# EasyEDA Pro project AgOopenHardwareMicro.eprj, board PCB_AIO v4.5 Micro AMP 2024-02-05 (continued)
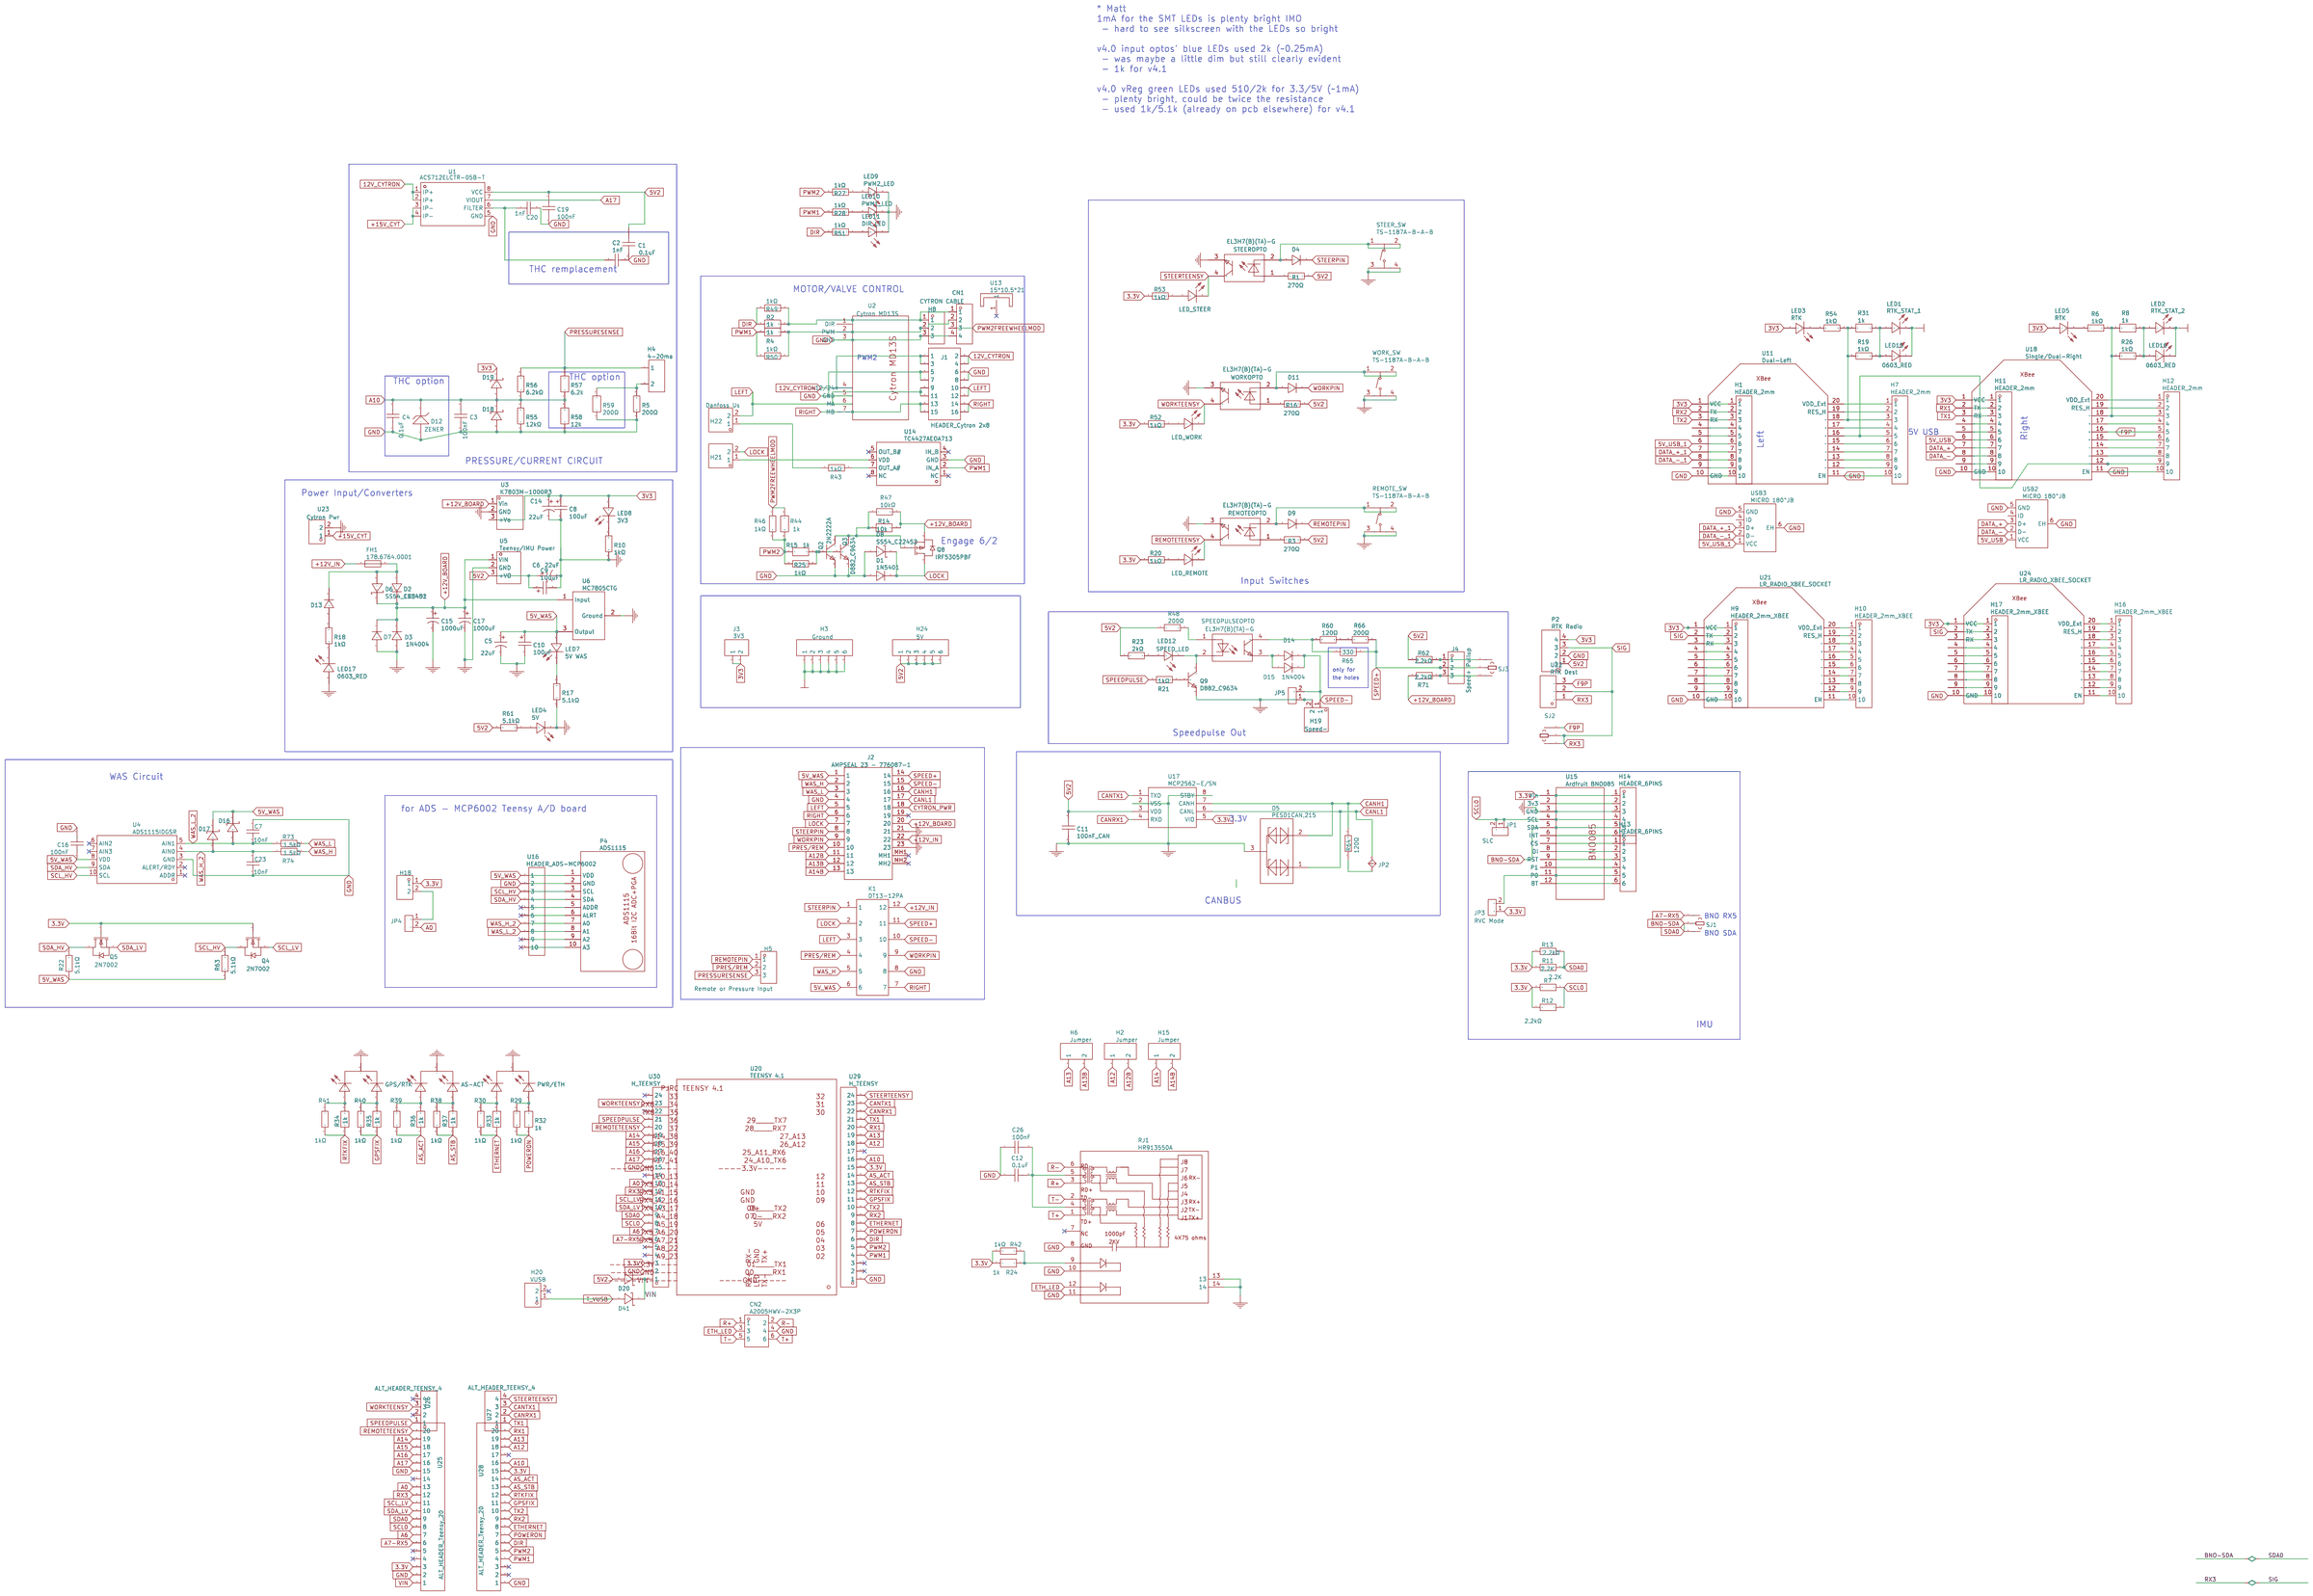
[diagram p0: schematic sheet]
## Routing (per net, layer and track width the routed paths; a pad name or vN(x,y) marks a point on that pad's centre or on a via; arc(x,y) is an arc through that point) (continued)
SPEED-: length 83
  Top Layer w0.254: 41.37,94.99 D14.1
  Inner2 w0.254: 12.8,113.19 12.83,113.19 12.83,110.99 8.38,106.55 8.38,96.77 10.16,94.99 35.18,94.99 36.58,93.34 39.75,93.34 41.37,94.99 ; D15.2 42.77,93.59 53.09,93.59 57.15,95.37 60.96,95.37 62.23,96.64 H19.1
  Bottom Layer w0.254: H19.1 JP5.2
SPEEDPULSE: length 54.6
  Top Layer w0.254: R21.2 57.4,64.89 v3(57.53,64.76)
  Inner2 w0.254: v3(57.53,64.76) 69.09,64.76 76.45,57.4 94.62,57.4 U30.21
STEERPIN: length 97.7
  Top Layer w0.254: v3(85.22,147.69) D4.1
  Inner1 w0.254: v3(28.96,141.47) 24.89,137.41 24.89,122.55 23.37,121.02 23.37,117.75 J2.8
  Bottom Layer w0.254: v3(85.22,147.69) 84.2,147.69 82.05,149.85 60.32,149.85 51.94,141.47 v3(28.96,141.47)
STEERTEENSY: length 132.4
  Top Layer w0.254: STEEROPTO.4 105.03,140.45 102.87,142.61 v3(89.92,142.61)
  Inner1 w0.254: v3(89.92,142.61) 89.92,115.05 98.3,106.67 98.3,53.08 99.31,52.37 101.35,50.34 101.35,38.22 U29.24
T+: length 63.2
  Inner1 w0.254: CN2.6 61.71,43.25
  Bottom Layer w0.254: RJ1.1 12.86,69.42 14.86,67.43 16.64,67.43 17.91,66.16 18.67,66.16 34.16,50.67 34.54,50.41 34.54,48.51 38.23,44.82 42.8,44.82 44.58,43.43 53.97,43.43 56.01,41.52 61.21,41.52 61.71,43.26
T-: length 63.2
  Bottom Layer w0.254: CN2.5 59.99,43.26 60.71,42.54 60.71,42.16 60.58,42.03 56.39,42.03 54.23,43.93 44.96,43.93 43.05,45.46 38.48,45.46 35.05,48.89 35.05,51.17 34.8,51.43 34.16,51.43 18.92,66.67 18.16,66.67 16.76,68.06 16.76,69.84 16.38,70.6 15.75,70.6 15.24,70.35 14.99,69.72 RJ1.2
T_VUSB: length 3.3
  Top Layer w0.584: D41.2 48.26,46.86 48.51,47.11 H20.1
TX1: length 96.6
  Bottom Layer w0.254: U29.21 97.54,33.9 93.17,29.54 78.71,29.54 72.88,23.71 29.85,23.71 U18.3
TX2: length 60.7
  Bottom Layer w0.254: U29.10 69.6,34.92 66.8,37.71 62.54,37.71 62.03,37.2 17.56,37.2 H1.3
U2_1: length 19.2
  Top Layer w0.254: R49.1 R2.2
  Inner2 w0.254: R2.2 68.07,61.71 67.44,60.95 61.47,60.95 CN1.1 61.09,58.02 U2.1
U2_2: length 17.9
  Top Layer w0.254: 65.15,62.87 65.28,62.99 R50.1
  Inner2 w0.254: R4.2 58.8,62.73 CN1.2 58.55,59.56 U2.2
U11_16: length 32.8
  Inner2 w0.254: H7.5 28.45,42.76 28.45,31.62 27.05,30.22 25.78,30.22 24.78,29.22 24.78,28.69
U11_18: length 21.8
  Top Layer w0.254: 10.65,50.54 12.78,52.67 H7.3 ; 10.41,50.54 15.44,50.54 16.58,51.68 R54.1
U14_6: length 10.2
  Top Layer w0.6: 58.22,85.43 56.55,85.43 55.12,83.99 55.12,81.91 56.9,80.13 H21.1
U14_7: length 17.4
  Top Layer w0.6: 68.33,82.21 65.74,79.62 59.31,79.62 56.39,82.54 56.39,83.69 56.9,84.19 58.17,84.19
U15_11: length 7.4
  Top Layer w0.254: JP3.2 89.15,86.73 91.95,83.94 U15.11
U18_18: length 21.8
  Top Layer w0.254: 10.41,24.63 R8.2 25.4,24.63 26.03,25.77 R6.1 ; 12.78,28.69 12.78,26.76 10.65,24.63
U26_3: length 0.8
  Inner2 w0.254: 41.4,92.32 40.64,92.32
WAS_H: length 69.3
  Top Layer w0.254: R74.2 78.1,125.6 v3(77.6,126.1)
  Inner2 w0.254: J2.2 16.8,135.66 17.66,136.52 19.56,136.52 20.32,137.28 32.02,137.28 32.78,136.52 59.82,136.52 v3(59.82,135.88)
  Bottom Layer w0.254: v3(77.6,126.1) 68.71,126.1 59.82,134.99 v3(59.82,135.88)
WAS_H_2: length 41.5
  Top Layer w0.254: 80.76,124.48 v3(77.34,124.48) ; C23.2 81.5,123.31 80.76,124.04 R74.1 ; v3(72.01,124.45) 71.4,124.45 71.37,124.48 ; 75.43,120.31 75.43,118.98 75.18,118.74 72.26,118.74 71.37,119.63 71.37,136.52 69.34,138.55 P4.7
  Bottom Layer w0.254: v3(72.01,124.45) 77.31,124.45 v3(77.34,124.48)
WAS_L: length 77.5
  Top Layer w0.254: v3(77.85,118.74) R73.2
  Inner2 w0.254: J2.3 17.78,131.18 20.57,133.6 35.81,132.07 38.99,134.23 54.23,134.23 61.21,127.25 64.77,127.25 66.17,125.85 66.17,117.34 67.18,116.32 70.87,116.32 73.28,118.74 v3(77.85,118.74)
WAS_L_2: length 37.2
  Top Layer w0.254: 75.93,118.1 77.09,118.1 77.6,117.59 80.26,117.59 80.76,118.11 R73.1 80.76,120.29 81.5,121.02 C7.1 ; 75.93,118.1 71.88,118.1 70.74,119.25 70.74,133.98 68.71,136.01 P4.8 ; 75.93,118.1 75.93,120.31
WORKPIN: length 101.2
  Top Layer w0.254: 87.12,155.85 85.95,155.85 v3(85.09,156.71)
  Inner1 w0.254: 12.83,137.19 5.9,137.19 5.9,145.08 17.53,156.71 v3(85.09,156.71)
WORKTEENSY: length 124.1
  Top Layer w0.254: v3(99.44,152.27) 103.12,152.27 105.03,150.36 WORKOPTO.4
  Inner1 w0.254: v3(99.44,152.27) 91.82,152.27 90.68,151.12 90.68,116.32 98.93,108.07 98.93,84.83 100.84,83.42 100.84,76.81 100.97,52.19 101.85,51.17 102.62,50.41 U30.23

## Copper pours and planes (outline as drawn; the poured copper is in the pictures)
12V_CYTRON on Top Layer: 63.88,126.99 63.88,124.96 61.72,124.96 61.72,126.99
12V_CYTRON on Top Layer: 60.15,117.21 65.02,117.21 65.02,112.13 60.15,112.13
12V_CYTRON on Top Layer: 61.85,126.87 63.75,126.87 63.75,125.09 61.85,125.09
12V_CYTRON on Bottom Layer: 60.15,117.21 65.02,117.21 65.02,112.13 60.15,112.13
+15VCYT on Top Layer: 61.85,129.41 63.63,129.41 63.63,127.63 61.85,127.63
+15VCYT on Top Layer: 63.82,129.53 63.82,127.5 61.66,127.5 61.66,129.53
GND on Top Layer: 54.86,112.13 54.86,117.21 59.82,117.21 59.82,112.13
GND on Top Layer: -19.01,172.3 121.45,172.3 127.29,166.46 127.29,-11.6 -12.53,-11.6 -17.61,-6.52
GND on Bottom Layer: -17.91,169.79 122.56,169.79 128.4,163.95 128.4,-14.1 -11.43,-14.1 -16.51,-9.02
GND on Bottom Layer: 54.8,112.13 54.8,117.21 59.75,117.21 59.75,112.13
GND on Inner1: -11.18,165.22 118.11,165.22 114.3,161.41 114.3,-6.48 112.27,-4.45 -11.18,-4.45
GND on Inner2: -2.29,151.63 -1.02,159.76 8.25,162.43 120.14,166.36 125.86,148.58 125.86,-16.77 122.56,-13.47 -4.95,-13.47
LEFT on Top Layer: 49.79,117.16 54.45,117.16 54.45,112.24 49.79,112.24
LEFT on Bottom Layer: 49.8,117.16 54.46,117.16 54.46,112.23 49.8,112.23
RIGHT on Top Layer: 44.39,117.21 49.42,117.21 49.42,112.2 44.39,112.2
RIGHT on Bottom Layer: 44.4,117.2 49.43,117.2 49.43,112.2 44.4,112.2

## Text on the board
Bottom Silkscreen Layer: 17-CAN1 LO | 18-CYT PWR | 16-CAN1 HI | 20-12V OUT | 22-12V IN | 21-GND | 23-GND | 19-NC | 10-PRES/REM | 14-SPEED+ | 15-SPEED- | 9-WORK PIN | 12-A13 | 11-A12 | 13-A14 | 4-GND | 5-LEFT | 7-LOCK | 3-WAS L | 6-RIGHT | 1-5V WAS | 8-STEER PIN | 2-WAS H | Speed- | GND | 12V | 5V | Speed+ | Cytron Power | Pin 18 - Alt | 12V Power | for Cytron | Danfoss | Danfoss Us | Cytron Pwr | Gnd | Pwr | Notes (date, installer, firmware):
Top Silkscreen Layer: PWM1 | GND | DIR | Speed+ | GND Black | PWM2 Red | PWM1 White | DIR Yellow | A0 | 3.3V | (default) | Teensy A12 A13 A14 | P11   P12   P13 | 5V Gnd Sig 3.3V | Speed- | solder jumper | on other side | 5V | 12V | solder for RCV | cut for RCV | term RES | I2C-SDA0 | RVC-RX5 | PRESSURE SENSE | ADS1115 | Cytron Power | Pin 18 - Alt | 12V Power | for Cytron | Danfoss only | CAN bus only | Remote | Work | Steer | VX7805-1000 | K7805M-1000 | Speed Pulse | + | 3V3 | 12V input | Inverted!! | Flashing - Float | RTK Dest | Green - RTK | Red - no RTK | Danfoss | Gnd | 5V WAS | Pressure | Pwr | PWM2 | F9P  Teensy | Xbee radio | 3V3 Test Pt | 5V Strip | Ground strip | Licenced under CERN-OHL-S-2.0 | 9 | 10 | 12 | 13 | 14 | 15 | 11 | Position | Heading_RelPos | F9P LEDs | 2 | 1 | 3 | 4 | 5 | 6 | 7 | 8 | Change log / - "no pads" Teensy footprint / - replaced C16133 100uF Tantalum to correct JLCPCB rotation conflict / - replaced green 0603 LEDs with 0805 | 20 | 18 | 19 | 21 | 22 | 23 | 16 | 17 | 776087-1 | AgOpenGPS | Micro V4.5
